# EasyEDA Pro project Cerberus_Sub_Controller_v02.eprj, board Cerberus_Sub_Controller_v02 (continued)
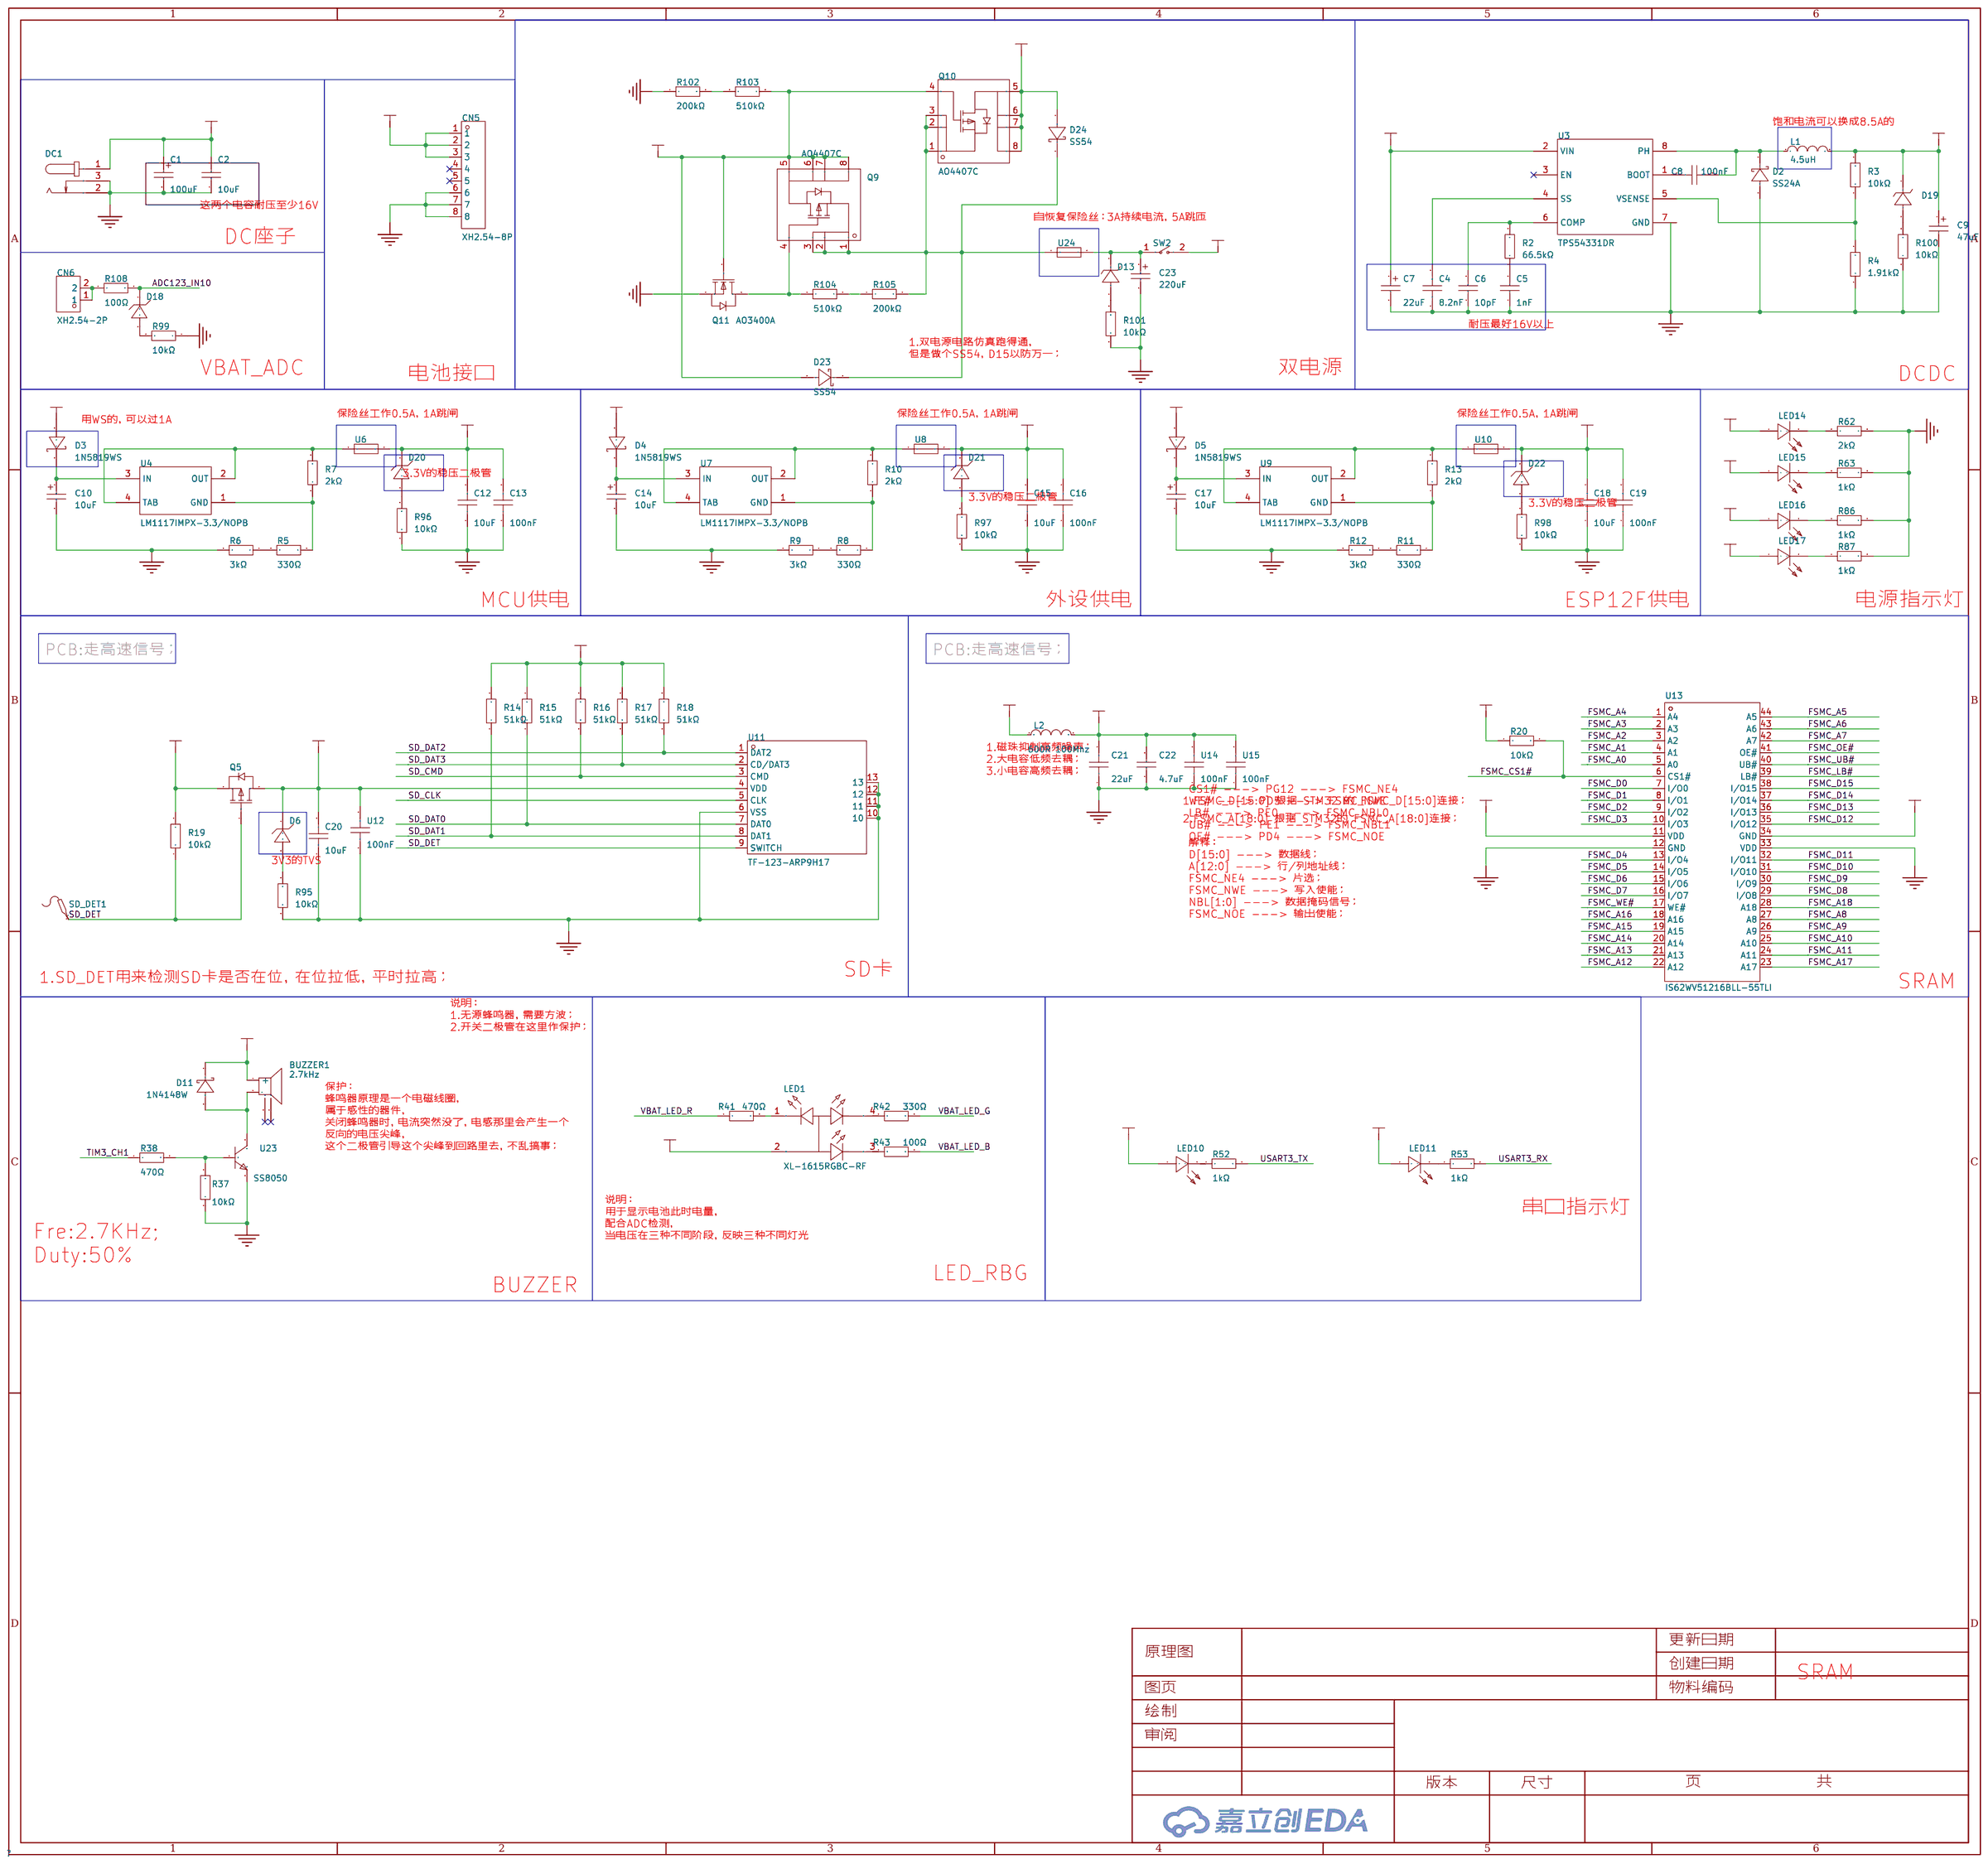
[diagram p0: A1]
## Routing (per net, layer and track width the routed paths; a pad name or vN(x,y) marks a point on that pad's centre or on a via; arc(x,y) is an arc through that point) (continued)
FSMC_A5: length 49.9
  Top Layer w0.203: U31.15 39.55,45.55 38.61,46.49 38.61,46.89 36.85,48.64 36.85,49.39 v1(36.83,49.41) ; 64.29,80.3 65.02,79.57 65.02,74.3 55.4,64.68 v1(54.91,64.68)
  Bottom Layer w0.203: v1(54.91,64.68) 52.19,64.68 36.92,49.41 v1(36.83,49.41)
FSMC_A6: length 34.4
  Top Layer w0.203: U31.50 48.14,66.17 49.02,66.17 50.04,65.16 55.25,65.16 64.52,74.43 64.52,78.95 63.73,79.74
FSMC_A7: length 33.9
  Top Layer w0.203: U13.42 64.01,78.33 64.01,74.55 54.99,65.54 50.29,65.54 49.28,66.55 46.4,66.55 U31.53
FSMC_A8: length 21.7
  Top Layer w0.203: U31.54 48.11,68.97 49.15,68.97 51.44,66.68 53.97,66.68 55.25,67.95 55.25,70.12 U13.27
FSMC_A9: length 20.9
  Top Layer w0.203: U31.55 47.91,69.47 49.28,69.47 51.69,67.06 53.72,67.06 54.74,68.08 54.74,69.5 U13.26
FSMC_A10: length 20.1
  Top Layer w0.203: U13.25 54.23,68.87 54.23,68.2 53.47,67.44 51.94,67.44 49.4,69.98 47.71,69.98 40.26,62.53
FSMC_A11: length 17.9
  Top Layer w0.203: U31.57 48.75,71.73 50.24,71.73 52.98,68.99
FSMC_A12: length 29.6
  Top Layer w0.203: 44.42,76.42 43.87,76.97 33.15,76.97 24.64,68.46 24.64,65.34 U31.87
FSMC_A13: length 31.5
  Top Layer w0.203: 44.98,76.99 44.5,77.47 32.89,77.47 24.13,68.71 24.13,65.16 25.44,63.84 25.44,63.83 U31.88
FSMC_A14: length 33.4
  Top Layer w0.203: 26.04,62.53 23.62,64.95 23.62,68.97 32.77,78.11 44.99,78.11 U13.20
FSMC_A15: length 35.2
  Top Layer w0.203: U13.19 45.62,78.62 32.51,78.62 23.11,69.22 23.11,64.75 25.69,62.17
FSMC_A16: length 30.2
  Top Layer w0.203: U31.80 27.69,67.25 27.69,69.47 33.66,75.44 42.93,75.44 43.81,74.55 45.79,74.55 47.12,75.88 47.12,78.25 46.68,78.69
FSMC_A17: length 28.4
  Top Layer w0.203: v1(49.53,71.25) 49.59,71.25 U13.23 ; U31.81 28.88,65.35 v1(30.35,63.89)
  Bottom Layer w0.203: v1(30.35,63.89) 32.77,63.89 40.13,71.25 v1(49.53,71.25)
FSMC_A18: length 32.5
  Top Layer w0.203: U31.82 27.56,65.96 v1(27.56,66.04) ; U13.28 54.1,72.39 v1(49.78,72.39)
  Bottom Layer w0.203: v1(49.78,72.39) 33.4,72.39 27.56,66.55 v1(27.56,66.04)
FSMC_CS1#: length 57.7
  Top Layer w0.203: 25.69,46.54 25.71,46.54 v1(26.92,47.76) ; v1(48.39,88.02) 48.9,88.52 50.42,88.52 U13.6 54.29,84.66 54.29,82.36 50.42,78.49 v1(50.42,75.95)
  Inner2 w0.381: v1(50.42,75.95) v1(37.34,62.87)
  Bottom Layer w0.203: v1(37.34,62.87) 35.31,60.84 35.31,57.79 26.92,49.41 v1(26.92,47.76)
FSMC_D0: length 45.8
  Top Layer w0.203: U31.85 25.65,65.74 25.65,68.08 33.53,75.95 43.05,75.95 44.07,74.93 45.47,74.93 46.35,75.82 46.35,76.11 v1(46.32,76.14) ; U13.7 50.94,86.87 v1(50.26,86.87)
  Bottom Layer w0.203: v1(46.32,76.14) 46.32,82.94 v1(50.26,86.87)
FSMC_D1: length 45.9
  Top Layer w0.203: v1(45.72,76.09) 44.94,75.31 44.45,75.31 43.31,76.46 33.4,76.46 25.15,68.2 25.15,65.54 U31.86 ; U13.8 50.44,86.24 v1(48.9,86.24)
  Bottom Layer w0.203: v1(45.72,76.09) 45.72,83.06 v1(48.9,86.24)
FSMC_D2: length 64
  Top Layer w0.203: U31.114 18.85,48.9 18.14,48.9 16.89,50.15 16.89,63.76 32.26,79.12 38.86,79.12 45.47,85.73 49.82,85.73 U13.9
FSMC_D3: length 65
  Top Layer w0.203: v1(44.2,85.22) 38.48,79.51 32,79.51 16.38,63.89 16.38,49.92 17.78,48.52 19.18,48.52 U31.115 ; v1(46.74,85.22) 49.19,85.22 U13.10
  Bottom Layer w0.203: v1(46.74,85.22) v1(44.2,85.22)
FSMC_D4: length 22.7
  Top Layer w0.203: U13.13 49.91,81.11 49.91,73.59 U31.58
FSMC_D5: length 21.8
  Top Layer w0.203: 39.19,63.59 49.4,73.79 49.4,80.49 U13.14
FSMC_D6: length 20.8
  Top Layer w0.203: 48.38,80.38 48.9,79.86 48.9,73.99 38.84,63.94
FSMC_D7: length 18.5
  Top Layer w0.203: 38.41,65.59 48.26,75.44 48.26,79.37 U13.16
FSMC_D8: length 22
  Top Layer w0.203: U13.29 54.73,72.9 v1(50.16,72.9) ; v1(44.94,72.92) 44.94,72.86 37.43,65.35
  Bottom Layer w0.203: v1(50.16,72.9) 50.14,72.92 v1(44.94,72.92)
FSMC_D9: length 23.1
  Top Layer w0.203: U13.30 55.35,73.41 v1(50.55,73.41) ; v1(44.45,73.41) 43.43,72.39 43.43,72.07 U31.65
  Bottom Layer w0.203: v1(50.55,73.41) v1(44.45,73.41)
FSMC_D10: length 24.2
  Top Layer w0.203: v1(43.94,73.92) 43.05,73.03 43.05,72.39 U31.66 ; v1(50.93,73.92) 55.97,73.92 U13.31
  Bottom Layer w0.203: v1(50.93,73.92) v1(43.94,73.92)
FSMC_D11: length 25.5
  Top Layer w0.203: U13.32 56.62,74.4 v1(51.31,74.4) ; v1(42.67,73.92) 42.67,72.72 U31.67
  Bottom Layer w0.203: v1(51.31,74.4) 43.15,74.4 v1(42.67,73.92)
FSMC_D12: length 27.8
  Top Layer w0.203: v1(51.69,74.93) 52.45,75.7 58.72,75.7 U13.35 ; U31.68 42.04,72.79 v1(42.04,74.05)
  Bottom Layer w0.203: v1(42.04,74.05) 42.93,74.93 v1(51.69,74.93)
FSMC_D13: length 37.4
  Top Layer w0.203: U13.36 59.34,76.2 52.2,76.2 v1(51.69,75.7) ; 30.28,66.77 30.26,66.77 28.96,68.08 28.96,70.11 33.78,74.93 v1(41.53,74.93)
  Bottom Layer w0.203: v1(41.53,74.93) 41.91,75.31 51.31,75.31 v1(51.69,75.7)
FSMC_D14: length 40.9
  Top Layer w0.203: v1(47.76,67.94) 48.15,68.33 49.15,68.33 51.18,66.3 54.23,66.3 55.63,67.69 55.63,69.73 60.83,74.93 60.83,75.85 60.34,76.34 ; U31.78 32.33,64.01 33.66,64.01 v1(34.67,65.03)
  Bottom Layer w0.203: v1(47.76,67.94) 37.58,67.94 v1(34.67,65.03)
FSMC_D15: length 42.8
  Top Layer w0.203: U13.38 61.34,76.47 61.34,74.74 56.01,69.41 56.01,67.44 54.48,65.92 50.8,65.92 49.02,67.69 48.26,67.69 v1(47.75,67.19) ; U31.79 32.52,63.12 v1(32.64,63.12)
  Bottom Layer w0.203: v1(47.75,67.19) 37.59,67.19 33.53,63.12 v1(32.64,63.12)
FSMC_LB#: length 50.6
  Top Layer w0.203: U31.141 32.13,43.09 32.13,46.87 v1(36.7,51.44) ; v1(56.77,69.47) 62.28,74.99 62.28,76.66 U13.39
  Bottom Layer w0.203: v1(56.77,69.47) 53.21,65.92 51.05,65.92 36.7,51.57 v1(36.7,51.44)
FSMC_OE#: length 55.6
  Top Layer w0.203: v1(56.75,67.97) 63.5,74.72 63.5,77.7 U13.41 ; v1(42.54,55.88) 38.61,51.95 24.73,51.95 U31.118
  Bottom Layer w0.203: v1(56.75,67.97) 53.93,65.16 51.82,65.16 v1(42.54,55.88)
FSMC_UB#: length 51.7
  Top Layer w0.203: v1(56.77,68.71) 62.85,74.79 62.85,77.22 U13.40 ; 30.99,41.24 32.64,42.89 32.64,46.61 v1(37.47,51.44)
  Bottom Layer w0.203: v1(37.47,51.44) 37.47,51.69 51.31,65.54 53.59,65.54 v1(56.77,68.71)
FSMC_WE#: length 64.3
  Top Layer w0.203: U31.119 20.74,47.25 18.42,47.25 15.88,49.79 15.88,64.01 31.88,80.01 38.1,80.01 v1(41.53,83.44) ; 47.25,79.25 45.09,81.41
  Bottom Layer w0.203: v1(41.53,83.44) 43.05,83.44 v1(45.09,81.41)
I2C1_SCL: length 61.9
  Top Layer w0.203: v1(24.38,23.89) 21.72,26.56 21.72,34.09 U31.139 ; 22.28,18.22 24.38,20.32 24.38,23.88 ; 22.28,18.22 R74.2 ; 22.28,18.22 22.28,16.06 20.32,14.1 20.32,7.24 19.18,6.1 6.62,6.1 CN4.2
  Bottom Layer w0.203: v1(24.38,23.89) 24.38,22.74 24.13,22.48 R69.2
I2C1_SDA: length 65.3
  Top Layer w0.203: CN4.1 20.19,4.45 24.64,8.89 24.64,13.47 23.82,14.28 R21.2 22.99,18.16 26.29,21.47 v1(26.29,23.88) 25.27,24.9 25.27,26.8 22.22,29.85 22.22,33.89 30.28,41.95
  Bottom Layer w0.203: R68.2 25.27,21.21 26.29,22.23 R70.1
LC02_CS: length 24.1
  Top Layer w0.203: U31.73 31.64,68.18 30.48,69.35 30.48,70.87 33.78,74.17 v1(37.85,74.17) ; v1(38.42,81.22) 38.42,84.01 37.72,84.71 R32.1
  Bottom Layer w0.203: v1(37.85,74.17) 37.97,74.17 38.42,74.62 v1(38.42,81.22)
LC02_CS_R: length 9.3
  Top Layer w0.203: v1(37.72,88.74) R32.2 R107.2
  Bottom Layer w0.203: 37.72,88.78 36.19,88.78 35.94,89.03 35.94,90.05 35.56,90.43 34.42,90.43 34.14,90.15 CN3.5
LC02_RXD: length 3.3
  Top Layer w0.203: R31.2 R27.1 33.46,88.79 v1(33.14,89.11)
LC02_TXD: length 1.9
  Top Layer w0.203: v1(32,88.79) R30.2
  Bottom Layer w0.203: CN3.3 32.14,88.92 v1(32,88.79)
LIS_CS: length 4.7
  Bottom Layer w0.203: R23.2 22.99,11.88 21.02,13.85 U17.3
  vias: v1(22.99,11.99)
LIS_INT: length 80.6
  Top Layer w0.203: v1(36.32,17.91) 36.32,12.85 35.57,12.1 R78.2 v1(30.86,12.07) ; v1(48.83,56.84) 48.83,57.85 47.75,58.93 46.56,58.93 45.21,57.58 ; v1(15.93,12.07) 15.93,13.33 v1(15.92,13.34)
  Bottom Layer w0.203: v1(15.92,13.34) 16.95,13.34 16.96,13.35 U17.7 ; v1(48.83,56.84) 36.32,44.33 v1(36.32,17.91) ; 15.88,12.07 15.88,11.31 17.27,9.91 23.11,9.91 25.27,12.07 v1(30.86,12.07)
LIS_SCL: length 4.3
  Top Layer w0.203: R72.1 v1(19.56,17.35) R74.1
  Bottom Layer w0.203: v1(19.56,17.35) 19.56,15.25 U17.1
LIS_SDA: length 8.5
  Top Layer w0.203: v1(19.84,13.34) 19.84,13.82 18.11,15.55 R73.1 ; v1(20.83,13.35) 20.89,13.41 R21.1
  Bottom Layer w0.203: U17.4 v1(20.83,13.35)
MPU6050_AUX_CL: length 5.6
  Top Layer w0.203: v1(16.26,19.82) 16.89,19.18 18.5,19.18 19.5,18.18 R72.2
  Bottom Layer w0.203: U16.7 16.29,19.85 v1(16.26,19.82)
MPU6050_AUX_DA: length 3
  Bottom Layer w0.203: v1(18.03,18.16) 17.04,19.16 U16.6
MPU6050_INT: length 52.7
  Top Layer w0.203: U31.22 42.97,47.01 42.97,46.03 41.53,44.58 41.53,42.04 45.34,38.23 45.34,35.06 43.43,33.15 23.37,33.15 v1(22.73,32.52)
  Bottom Layer w0.203: R67.1 13.92,24.13 v1(13.92,26.14) ; 13.97,26.29 20.19,32.52 v1(22.73,32.52)
NRST: length 102.7
  Top Layer w0.203: 3.68,43.56 2.79,43.56 1.65,42.42 1.65,23.25 3.01,21.89 C58.1 R89.2 ; U31.25 44.09,48.01 46.1,48.01 46.74,48.64 50.16,48.64 52.45,46.36 52.45,41.28 43.69,32.52 v1(23.62,32.52)
  Bottom Layer w0.203: 3.68,43.56 13.59,43.56 14.61,42.55 14.61,41.53 v1(23.62,32.52)
  vias: v1(6.66,23.71)
OSC32_IN: length 9.2
  Top Layer w0.254: U31.8 40.14,39.95 40.14,36.46 39.31,35.63 C57.2
OSC32_OUT: length 8.3
  Top Layer w0.254: X2.2 41.91,38.49 C56.2 41.66,40.26 40.53,40.26 37.43,43.36
OSC_IN: length 13.4
  Top Layer w0.254: R88.1 47.65,42.37 46.83,43.18 45.68,42.04 C55.2 44.45,42.04 43.69,42.8 43.69,44.2 44.83,45.34 44.83,45.86 U31.23
OSC_OUT: length 13.5
  Top Layer w0.254: U31.24 45.16,46.23 46.89,46.23 47.15,45.98 47.74,45.98 C54.2 50.03,46.87 50.8,46.11 50.8,44.2 R88.2
PDR_ON: length 5.7
  Top Layer w0.203: U31.143 30.39,39.94 30.39,38.19 v1(31.24,37.34)
  Bottom Layer w0.508: v1(31.24,37.34) R40.2
SD_CLK: length 16.8
  Top Layer w0.203: U31.113 18.78,49.53 18.29,49.53 17.52,50.3 v1(17.52,50.93)
  Bottom Layer w0.203: v1(17.52,50.93) 17.4,51.05 17.4,52.58 14.94,55.04 U11.5
SD_CMD: length 19.2
  Top Layer w0.203: v1(19.56,48.14) 19.56,48.19 U31.116 ; R16.1 8.43,52.97 v1(8.3,52.84)
  Bottom Layer w0.203: 19.43,48.14 16.89,50.68 16.89,52.33 16.38,52.84 v1(8.3,52.84)
SD_DAT0: length 17.2
  Top Layer w0.203: v1(17.78,60.96) 21.24,60.96 U31.98
  Bottom Layer w0.203: v1(17.78,60.96) 15.37,60.96 13.08,58.68 10.19,58.68 v1(10.03,58.52) 10.03,57.79 9.48,57.24 U11.7
SD_DAT1: length 16.5
  Top Layer w0.203: U31.99 21.17,60.33 v1(17.78,60.33) ; v1(11.3,58.17) 10.54,57.41 8.89,57.41 8.38,57.92 v1(8.38,58.34)
  Bottom Layer w0.203: v1(17.78,60.33) 15.37,60.33 13.21,58.17 v1(11.3,58.17)
SD_DAT2: length 19.3
  Top Layer w0.203: U31.111 20.7,52.87 20.7,53.6 v1(20.32,53.98) ; v1(14.48,56.39) 14.48,53.96 13.49,52.97 R18.1 13.43,52.97 11.1,50.64 v1(8.3,50.64)
  Bottom Layer w0.203: v1(14.48,56.39) 14.73,56.65 17.65,56.65 v1(20.32,53.98)
SD_DAT3: length 22.5
  Top Layer w0.203: R17.1 11.78,52.97 10.55,51.74 v1(8.3,51.74) ; U31.112 19.09,50.55 18.58,50.55 18,51.13 v1(18,51.6)
  Inner2 w0.381: v1(8.3,51.74) 9.27,52.71 9.27,54.87 10.03,55.63 v1(13.97,55.63)
  Bottom Layer w0.203: v1(18,51.6) 18,52.61 14.99,55.63 v1(13.97,55.63)
SD_DET: length 15.9
  Top Layer w0.381: R19.1 6.53,55.44 v1(5.19,55.44)
  Bottom Layer w0.203: SD_DET1.1 8.26,47.38 5.84,47.38 4.32,48.9 4.32,52.71 5.19,53.58 v1(5.19,55.44)
  Bottom Layer w0.381: v1(6.73,55.6) 6.73,54.61 7.06,54.29 8.3,54.29
SPI1_CLK: length 41.3
  Top Layer w0.203: v1(24.38,38.23) 24.38,41 U31.133
  Bottom Layer w0.203: v1(24.38,38.23) 24.38,30.99 28.57,26.8 28.57,15.37 33.91,10.04 35.43,10.04
  vias: v1(35.53,10.04)
SPI1_CS: length 60.7
  Top Layer w0.203: U31.104 22.2,55.76 23.11,55.76 26.42,52.45 v1(30.99,52.45)
  Inner2 w0.381: v1(51.82,20.58) 54.61,17.78 v1(54.61,14.1) ; v1(34.29,38.1) v1(44.45,27.94)
  Bottom Layer w0.203: v1(34.29,38.1) 32.38,40.01 32.38,51.69 31.62,52.45 v1(30.99,52.45) ; v1(44.45,27.94) v1(51.82,20.58)
SPI1_MOSI: length 38.1
  Top Layer w0.203: U31.135 25.02,40.22 v1(25.02,38.99)
  Bottom Layer w0.203: 35.56,14.16 30.92,14.16 29.97,15.12 29.97,18.29 29.08,19.18 29.08,27.31 25.02,31.37 v1(25.02,38.99)
  vias: v1(35.54,14.1)
SWCLK: length 34.7
  Top Layer w0.203: v1(12.7,57.15) v1(12.7,53.72) ; v1(12.57,48.14) 11.3,46.87 11.3,42.93 6.86,38.48 H12.4 ; 19.33,52.91 17.78,54.45 v1(17.78,57.15)
  Inner2 w0.381: v1(12.57,48.14) 12.57,53.6 v1(12.7,53.72)
  Bottom Layer w0.203: v1(17.78,57.15) 17.27,57.66 13.21,57.66 v1(12.7,57.15)
SWDIO: length 32.3
  Top Layer w0.203: v1(14.99,58.55) 14.99,51.57 10.67,47.25 10.67,43.06 8.64,41.03 H12.3 ; v1(17.91,59.44) 17.91,59.35 U31.105
  Bottom Layer w0.203: v1(17.91,59.44) 15.37,59.44 14.99,59.06 v1(14.99,58.55)
TIM3_CH1: length 21.4
  Top Layer w0.203: R38.1 20.95,70.37 v1(21.21,70.11) ; U31.96 22.61,61.01 v1(22.61,68.71)
  Bottom Layer w0.203: v1(22.61,68.71) v1(21.21,70.11)
UART4_RX: length 50.6
  Top Layer w0.203: 46.62,52.56 47.57,51.6 48.04,51.6 54.36,57.92 54.36,59.95 59.82,65.41 61.09,65.41 79.21,83.53 R36.1
UART4_TX: length 52.3
  Top Layer w0.203: U31.34 47.22,51.25 48.2,51.25 54.74,57.79 54.74,59.76 59.88,64.9 61.09,64.9 81.75,85.57 R35.1
USART1_RX: length 32
  Top Layer w0.203: U31.102 20.32,59.06 v1(20.32,59.69)
  Bottom Layer w0.203: H11.2 4.28,79.51 10.89,72.89 R33.1 10.95,72.89 11.7,72.14 15.62,72.14 20.32,67.44 v1(20.32,59.69)
USART1_TX: length 33.3
  Top Layer w0.203: U31.101 20.95,59.13 v1(20.95,59.69)
  Bottom Layer w0.203: v1(20.95,59.69) 20.95,67.57 15.63,72.89 R34.1 12.8,72.89 3.65,82.05 H11.3
USART2_RX: length 103.1
  Top Layer w0.203: v1(48.64,53.47) 48.64,54.14 U31.37 47.34,56.17 47.47,56.17 47.76,55.88 48.77,55.88 59.56,66.68 59.56,67.06 60.58,68.08 61.09,68.08 70.36,77.35 70.36,90.05 H4.2
  Bottom Layer w0.203: v1(48.64,53.47) 51.69,53.47 55.12,50.04 55.12,23.5 58.8,19.82 58.8,9.4 59.82,8.39 H8.2
USART2_TX: length 91.8
  Top Layer w0.203: v1(48.9,55.25) 59.82,66.17 60.71,66.17 61.59,67.06 61.59,67.69 70.87,76.97 H4.3 ; v1(47.62,53.47) 47.06,52.91 U31.36
  Bottom Layer w0.203: H9.2 60.07,19.31 55.63,23.75 55.63,50.17 51.84,53.95 48.1,53.95 ; 48.1,53.95 48.9,54.74 v1(48.9,55.25) ; 48.1,53.95 v1(47.62,53.47)
USART3_RX: length 27.2
  Top Layer w0.203: v1(40.26,73.03) 40.26,72.43 35.31,67.47 ; v1(32.38,83.44) 32.38,83.69 R53.2 R30.1
  Inner2 w0.381: v1(32.38,83.44) 33.91,83.44 34.29,83.06 38.74,83.06 40.26,81.54 v1(40.26,73.03)
USART3_TX: length 26.2
  Top Layer w0.203: R31.1 34.8,84.2 ; v1(40.89,73.03) 40.89,72.36 U31.69 ; v1(34.8,83.7) R52.2
  Inner2 w0.381: v1(40.89,73.03) 40.89,81.79 38.99,83.7 v1(34.8,83.7)
  Bottom Layer w0.381: v1(34.8,83.7) 34.91,83.58 TP19.1
$1N1726: length 1.8
  Top Layer w0.508: C4.2 87.53,51.88 U3.4
$1N1843: length 1.8
  Bottom Layer w0.508: C5.2 R2.1
$1N1949: length 2.2
  Bottom Layer w0.508: v1(86.24,57.28) 86.29,57.23 C6.2
$1N2122: length 2.5
  Top Layer w0.508: U3.1 v1(83.69,54.42)
$1N2501: length 3.8
  Top Layer w0.508: U3.5 87.54,57.28 R4.2 89.53,57.29 R3.1
$1N2585:
  vias: v1(79.12,60.08) v1(79.12,59.18) v1(79.12,58.17) v1(80.23,60.1) v1(80.23,59.2) v1(80.23,58.19) v1(80.23,57.12) v1(81.46,60.1) v1(81.46,59.2) v1(81.46,58.19) v1(81.46,57.12) v1(82.59,60.1) v1(82.59,59.2) v1(82.59,58.19) v1(82.59,57.12) v1(83.69,60.1) v1(83.69,59.2) v1(83.69,58.19) v1(83.69,57.12) v1(83.69,55.76)
$1N3113: length 1.5
  Bottom Layer w0.508: R5.2 69.99,57.92 R6.1
$1N3446: length 0.9
  Bottom Layer w0.508: R7.2 v1(68.45,58.81)
  vias: v2(66.29,60.08)
$1N4301: length 1.5
  Bottom Layer w0.508: R9.1 69.86,46.61 R8.2
$1N4315: length 0.9
  Bottom Layer w0.508: v1(68.33,47.5) R10.2
  vias: v2(66.17,48.77)
$1N4707: length 1.5
  Bottom Layer w0.508: R11.2 69.6,35.56 R12.1
$1N4721: length 0.8
  Bottom Layer w0.508: v2(68.01,36.33) 68.07,36.26 R13.2
  vias: v2(65.91,37.34)
$1N4748:
  vias: v2(68.07,34.03) v2(69.6,34.03)
$1N4784:
  vias: v2(68.33,45.12) v2(69.85,45.12)
$1N4807:
  vias: v2(68.45,56.38) v2(70.1,56.38)
$1N4899: length 2.6
  Top Layer w0.762: v2(71.73,60.96) 69.29,60.96 U4.3
$1N4974: length 2.6
  Top Layer w0.762: C14.1 71.27,49.8 U7.3
  vias: v2(71.73,49.53)
$1N5020: length 3.1
  Top Layer w0.762: v2(71.75,38.46) C17.1 71.65,38.63 U9.3
$1N9180: length 2.2
  Top Layer w0.508: BUZZER.2 18.42,84.71 v1(16.47,84.71)
  vias: v1(18.54,84.06)
$1N9181: length 1.7
  Bottom Layer w0.203: U23.1 19.4,81.97 v1(19.4,80.39)
$1N9349: length 5.8
  Bottom Layer w0.203: v1(7.63,32.77) 5.59,32.77 4.76,31.94 4.76,30.42 5.12,30.06 Battery_led.1
$1N9353: length 0.4
  Top Layer w0.203: R43.1 7.37,30.92 v1(7.34,30.92)
$1N9484: length 0.7
  Top Layer w0.203: v1(7.23,30) 7.63,29.61 R42.1
$1N10259: length 1.6
  Top Layer w0.203: R52.1 34.89,82.47 v1(34.89,81)
$1N10263: length 1.6
  Top Layer w0.203: v1(31.55,81.15) 32,81.6 R53.1
$1N11173:
  vias: v1(86.46,37.88) v1(86.46,36.58) v1(86.46,35.22) v1(86.46,33.92) v1(86.49,32.75) v1(86.49,31.52) v1(88.1,37.88) v1(88.1,36.58) v1(88.1,35.22) v1(88.1,33.92) v1(88.13,32.75) v1(88.13,31.52) v1(89.55,37.88) v1(89.55,36.58) v1(89.55,35.22) v1(89.55,33.92) v1(89.58,32.75) v1(89.58,31.52) v1(89.88,39.37) v1(91.06,39.37) v1(91.08,37.88) v1(91.08,36.58) v1(91.08,35.22) v1(91.08,33.92) v1(91.11,32.75) v1(91.11,31.52)
$1N12165:
  vias: v1(78.61,44.49)
$1N12423:
  vias: v1(73.03,68.04)
$1N13016:
  vias: v1(56.26,55.6)
$1N13023: length 2.3
  Bottom Layer w0.381: MCU_3V3#2.2 62.35,69.57 R87.1
$1N13155: length 2.3
  Top Layer w0.381: R95.2 6,50.3 D6.2
$1N13401: length 2.6
  Bottom Layer w0.635: R97.2 64.01,48.87
$1N13531: length 2.2
  Top Layer w0.381: D18.2 83.1,74.4 R99.2
$1N13687: length 1.8
  Bottom Layer w0.508: 87.11,62.95 86.9,62.75 D19.2
$1N13763: length 2.5
  Bottom Layer w0.635: R96.2 D20.2
$1N13849: length 2.4
  Bottom Layer w0.635: D22.2 R98.2
$1N13895: length 1.8
  Bottom Layer w0.508: D13.2 R101.2
$1N18758: length 1.8
  Top Layer w0.762: R103.1 R102.2
$1N19044: length 1.8
  Bottom Layer w0.762: R105.1 R104.2
$1N19049:
  vias: v1(84.96,21.48)
$1N19262:
  vias: v1(82.44,28.58) v1(82.44,27.31) v1(82.44,26.04) v1(83.69,28.58) v1(83.69,27.47) v1(83.69,26.42) v1(84.99,28.55) v1(84.99,27.44) v1(84.96,26.29) v1(86.23,28.55) v1(86.23,27.44) v1(86.23,26.04) v1(86.23,24.64) v1(86.23,23.04) v1(86.23,21.48) v1(87.5,28.55) v1(87.5,27.44) v1(87.5,26.04) v1(87.5,24.64) v1(87.5,23.04) v1(87.5,21.48) v1(88.77,28.55) v1(88.77,27.44) v1(88.77,26.04) v1(88.77,24.64) v1(88.77,23.04) v1(88.77,21.48) v1(89.82,19.31) v1(90.17,28.53) v1(90.17,27.42) v1(90.17,26.02) v1(90.17,24.63) v1(90.17,23.02) v1(90.17,21.47) v1(91.41,28.53) v1(91.41,27.42) v1(91.41,26.02) v1(91.41,24.63) v1(91.41,23.02) v1(91.41,21.47)
$1N26422: length 4.9
  Top Layer w0.381: R108.1 86.75,78.22 CN6.1 CN6.2
$2N204: length 3.4
  Bottom Layer w0.254: USB1.4 4.97,67.72 4.44,67.19 4.44,66.52 v1(4.35,66.42)
$2N205: length 2.8
  Bottom Layer w0.254: USB1.10 5.27,70.72 v1(4.35,71.63)
$2N447: length 3.7
  Bottom Layer w0.203: R34.2 12.83,69.47 13.84,68.46 v1(14.24,68.46)
$2N448: length 6.8
  Bottom Layer w0.203: R33.2 10.92,68.46 12.19,67.19 v1(14.24,67.19)
$2N1006: length 1.9
  Top Layer w0.203: R36.2 79.21,89.99 U22.3
$2N1007: length 1.9
  Top Layer w0.203: U22.2 81.75,90.03 R35.2
$2N1573: length 1.4
  Bottom Layer w0.203: U16.9 14.92,22.49 R66.2
$2N1574: length 1.5
  Bottom Layer w0.203: U16.10 15.75,22.99 15.49,23.25 v1(14.9,23.25)
$2N1575: length 1.4
  Bottom Layer w0.203: U16.12 14.93,23.99 R67.2
$2N1580: length 1.4
  Bottom Layer w0.203: U16.20 20.98,23.49 C26.1
$2N1581: length 1.6
  Bottom Layer w0.203: R68.1 21.52,21.49 U16.24
$2N1582: length 1.7
  Bottom Layer w0.203: U16.23 21.3,21.99 R69.1
$2N2781: length 1.7
  Bottom Layer w0.203: U17.5 18.54,11.98 C30.2
$2N7074: length 2.9
  Top Layer w0.203: v1(37.66,6.13) 35.46,6.13 35.43,6.11 R75.2
$2N7151: length 5.2
  Top Layer w0.203: R85.2 58.2,5.18 57.53,5.85
  Inner2 w0.381: H8.1 57.53,5.85
$2N7152: length 5.1
  Top Layer w0.203: R76.2 58.16,15.76 57.53,16.39
  Inner2 w0.381: H9.1 57.53,16.39
$2N7340: length 5.3
  Top Layer w0.203: v1(33.5,18.65) 31.69,18.65 30.73,17.69 R81.2 30.67,17.6 C52.2
$2N7398: length 4.4
  Top Layer w0.203: v1(26.32,3.08) 26.47,2.93 C53.2 28.76,4.78 R84.2
$3N7064:
  vias: v1(12.45,45.42)
$3N7085:
  vias: v1(12.45,42.34)
$3N7148: length 1.8
  Top Layer w0.203: v1(6.28,19.18) 6.66,19.57 C58.2

## Copper pours and planes (outline as drawn; the poured copper is in the pictures)
GND on Top Layer: -4.7,96.91 98.68,96.91 98.68,-9.14 -4.7,-9.14
GND on Bottom Layer: -3.56,99.06 99.57,99.06 99.57,-6.73 -3.56,-6.73
GND on Inner1: 0.26,94.74 94.74,94.74 94.74,0.26 0.26,0.26
GND on Inner2: -1.65,97.29 98.43,97.29 98.43,-8.12 -1.65,-8.12
VCC_5V on Top Layer: 75.18,51.06 74.39,50.26 73.37,50.26 73.15,50.04 73.15,49.03 73.37,48.81 74.39,48.81 75.18,48.01
VCC_5V on Top Layer: 81.41,69.6 80.52,70.49 80.52,70.74 80.01,70.74 80.01,70.49 78.65,68.97 81.99,68.97
VCC_5V on Top Layer: 78.49,69.6 75.56,69.6 74.8,68.84 74.8,49.12 74.84,49.08 74.84,38.1 75.09,37.85 77.09,37.85 77.47,38.23 77.47,63.07 78.15,63.75 78.15,69.27
VCC_5V on Top Layer: 85.34,63.69 86.05,64.4 86.05,68.9 85.34,69.6 78.36,69.6 77.6,68.84 77.6,64.25 78.15,63.69
VCC_5V on Top Layer: 75.18,62.49 74.39,61.69 73.37,61.69 73.15,61.47 73.15,60.46 73.37,60.24 74.39,60.24 75.18,59.44
VCC_5V on Top Layer: 75.31,37.85 73.28,37.85 73.15,37.98 73.15,39.25 73.28,39.37 74.6,39.37 75.03,39.8 75.31,39.52
VCC_5V on Bottom Layer: 78.49,69.6 75.56,69.6 74.8,68.84 74.8,49.12 74.84,49.08 74.84,38.07 75.06,37.85 77.09,37.85 77.47,38.23 77.47,63.07 78.15,63.75 78.15,69.27
VCC_5V on Bottom Layer: 75.18,62.49 74.39,61.69 73.37,61.69 73.15,61.47 73.15,60.46 73.37,60.24 74.39,60.24 75.18,59.44
VCC_5V on Bottom Layer: 85.34,63.69 86.05,64.4 86.05,68.9 85.34,69.6 78.36,69.6 77.6,68.84 77.6,64.25 78.15,63.69
VCC_5V on Bottom Layer: 75.31,37.85 73.28,37.85 73.15,37.98 73.15,39.25 73.28,39.37 74.6,39.37 75.03,39.8 75.31,39.52
VCC_5V on Bottom Layer: 75.18,51.06 74.39,50.26 73.37,50.26 73.15,50.04 73.15,49.03 73.37,48.81 74.39,48.81 75.18,48.01
VCC_5V on Inner2: 78.49,69.6 75.56,69.6 74.8,68.84 74.8,49.12 74.84,49.08 74.84,38.07 75.06,37.85 77.09,37.85 77.47,38.23 77.47,63.07 78.15,63.75 78.15,69.27
VCC_5V on Inner2: 75.18,51.06 74.39,50.26 73.37,50.26 73.15,50.04 73.15,49.03 73.37,48.81 74.39,48.81 75.18,48.01
VCC_5V on Inner2: 75.31,37.85 73.28,37.85 73.15,37.98 73.15,39.25 73.28,39.37 74.6,39.37 75.03,39.8 75.31,39.52
VCC_5V on Inner2: 75.18,62.49 74.39,61.69 73.37,61.69 73.15,61.47 73.15,60.46 73.37,60.24 74.39,60.24 75.18,59.44
VCC_5V on Inner2: 85.34,63.69 86.05,64.4 86.05,68.9 85.34,69.6 78.36,69.6 77.6,68.84 77.6,64.25 78.15,63.69
VCC_7V4 on Top Layer: 84.76,43.18 83.87,44.08 83.87,50.47 84.33,50.93 84.33,53.47 84.71,53.85 85.49,53.85 85.49,53.83 85.72,53.6 85.72,50.93 87.07,49.59 89.23,49.59 90.04,48.77 90.04,43.82 89.41,43.18
VCC_7V4 on Bottom Layer: 84.76,43.18 83.87,44.08 83.87,50.47 84.33,50.93 84.33,53.47 84.71,53.85 85.49,53.85 85.49,53.83 85.72,53.6 85.72,50.93 87.07,49.59 89.23,49.59 90.04,48.77 90.04,43.82 89.41,43.18
VCC_7V4 on Inner2: 84.76,43.18 83.87,44.08 83.87,50.47 84.33,50.93 84.33,53.47 84.71,53.85 85.49,53.85 85.49,53.83 85.72,53.6 85.72,50.93 87.07,49.59 89.23,49.59 90.04,48.77 90.04,43.82 89.41,43.18
VCC_BAT_7V4 on Top Layer: 73.03,21.34 70.74,21.34 69.6,22.48 69.6,28.58 70.61,29.59 78.45,29.59 78.87,29.17 78.87,24.01 78.49,23.63 74,23.63 73.43,23.06 73.43,21.74
VCC_BAT_7V4 on Bottom Layer: 72.96,21.33 70.67,21.33 69.53,22.47 69.53,28.57 70.54,29.58 78.38,29.58 78.8,29.16 78.8,24 78.42,23.61 73.93,23.61 73.36,23.05 73.36,21.73
VCC_BAT_7V4 on Inner2: 73.03,21.34 70.74,21.34 69.6,22.48 69.6,28.58 70.61,29.59 78.45,29.59 78.87,29.17 78.87,24.01 78.49,23.63 74,23.63 73.43,23.06 73.43,21.74
VCC_DC_7V4 on Top Layer: 92.71,17.78 90.17,17.78 89.66,17.28 84.07,17.28 83.31,18.04 83.31,20.71 83.06,20.96 82.04,20.96 81.79,20.71 81.79,16.77 83.31,15.24 83.31,10.93 83.06,10.67 83.06,8.89 83.57,8.39 88.01,8.39 88.65,9.02 88.65,13.5 89.38,14.23 91.69,14.23 92.71,15.24
VCC_DC_7V4 on Bottom Layer: 92.71,17.78 90.17,17.78 89.66,17.28 84.07,17.28 83.31,18.04 83.31,20.71 83.06,20.96 82.04,20.96 81.79,20.71 81.79,16.77 83.31,15.24 83.31,10.93 83.06,10.67 83.06,8.89 83.57,8.39 88.01,8.39 88.65,9.02 88.65,13.47 89.41,14.23 91.69,14.23 92.71,15.24
VCC_DC_7V4 on Inner2: 92.71,17.78 90.17,17.78 89.66,17.28 84.07,17.28 83.31,18.04 83.31,20.71 83.06,20.96 82.04,20.96 81.79,20.71 81.79,16.77 83.31,15.24 83.31,10.93 83.06,10.67 83.06,8.89 83.57,8.39 88.01,8.39 88.65,9.02 88.65,13.5 89.38,14.23 91.69,14.23 92.71,15.24
VCC_ESP_3V3 on Bottom Layer: 67.05,39.12 67.31,39.38 67.31,40.9 66.8,41.41 57.91,41.41 57.4,40.9 57.4,39.63 57.92,39.12
VCC_ESP_3V3 on Inner2: 44.96,18.39 43.97,19.31 46.35,19.31 45.44,18.39
VCC_ESP_3V3 on Inner2: 67.05,39.11 67.31,39.37 67.31,40.9 66.8,41.41 57.91,41.41 57.4,40.9 57.4,39.63 57.92,39.11
VCC_FSMC_3V3 on Bottom Layer: 55,80.27 57.2,82.48 59.05,82.48 59.77,81.75 59.81,81.75 59.81,81.28 57.03,78.49 56.83,78.49 55.04,80.27
VCC_MCU_3V3 on Bottom Layer: 67.85,61.71 68.11,61.97 68.11,63.49 67.6,64 57.69,64 57.31,63.62 57.31,62.22 57.83,61.71
VCC_MCU_3V3 on Inner2: 67.81,61.72 68.07,61.98 68.07,63.76 67.82,64.02 57.79,64.02 57.28,63.51 57.28,62.24 57.79,61.72
VCC_PER_3V3 on Bottom Layer: 67.38,50.74 67.64,51 67.64,52.52 67.13,53.03 58.24,53.03 57.73,52.52 57.73,51.25 58.25,50.74
VCC_PER_3V3 on Bottom Layer: 16,15.06 17.2,15.06 17.41,14.85 17.41,14.35 17.2,14.14 15.83,14.14 15.75,14.23 15.75,14.81
VCC_PER_3V3 on Inner2: 18.92,28.83 18.92,29.85 20.32,28.45 19.3,28.45
VCC_PER_3V3 on Inner2: 26.03,79.76 26.78,79.01 26.78,78.72 26.04,77.98 26.03,77.98
VCC_PER_3V3 on Inner2: 67.41,50.7 67.67,50.96 67.67,52.49 67.17,53 58.28,53 57.77,52.49 57.77,51.22 58.28,50.7
VCC_PER_3V3 on Inner2: 27.56,86.75 27.56,89.73 28.13,90.3 30.2,90.3 30.42,90.08 30.42,87.02 29,85.6 28.71,85.6
VCC_PER_3V3 on Inner2: 25.91,83.19 27.31,81.79 27.31,81.28 25.91,79.73
VCC_PER_3V3 on Inner2: 14.73,60.2 15.62,61.09 15.62,59.03 14.73,59.92
VCC_PER_3V3 on Inner2: 14.86,63.89 15.88,64.9 15.88,62.36 14.86,63.38
VCC_PER_3V3 on Inner2: 15.11,54.75 15.13,54.75 15.75,55.38 15.75,53.7 15.11,54.34
VCC_PER_3V3 on Inner2: 11.05,15.5 11.68,14.86 11.68,14.45 11.65,14.45 11.05,13.85
VCC_PER_3V3 on Inner2: 15.62,35.66 15.62,33.91 14.81,34.72 14.81,34.85
VCC_PER_3V3 on Inner2: 16.61,31.12 16.76,31.27 16.76,32.26 18.03,30.99 17.27,30.99 17.02,30.74 16.99,30.74
$1N2585 on Top Layer: 84.33,55.73 83.97,55.37 82.73,55.37 81.61,56.49 79.41,56.49 78.49,57.42 78.49,61.22 78.74,61.47 83.31,61.47 84.33,60.46
$1N2585 on Bottom Layer: 84.33,55.73 83.97,55.37 82.73,55.37 81.61,56.49 79.41,56.49 78.49,57.42 78.49,61.22 78.74,61.47 83.31,61.47 84.33,60.46
$1N2585 on Inner2: 84.33,55.73 83.97,55.37 82.73,55.37 81.61,56.49 79.41,56.49 78.49,57.42 78.49,61.22 78.74,61.47 83.31,61.47 84.33,60.46
$1N3446 on Top Layer: 67.82,59.33 66.61,60.54 62.29,60.54 62.22,60.47 62.22,57.07 66.61,57.07 67.85,58.31 70.39,58.31 69.38,59.33
$1N4315 on Top Layer: 67.68,48.02 66.46,49.24 62.15,49.24 62.08,49.17 62.08,45.77 66.46,45.77 67.7,47.01 70.25,47.01 69.23,48.02
$1N4721 on Top Layer: 67.45,36.83 66.23,38.05 61.92,38.05 61.85,37.98 61.85,34.58 66.23,34.58 67.47,35.82 70.02,35.82 69,36.83
$1N4748 on Top Layer: 70.14,34.3 69.91,34.54 67.65,34.54 67.44,34.32 67.44,33.66 67.69,33.41 69.87,33.41 70.14,33.67
$1N4784 on Top Layer: 70.4,45.6 70.17,45.83 67.79,45.83 67.57,45.61 67.57,44.83 67.95,44.45 70.14,44.45 70.4,44.71
$1N4807 on Top Layer: 70.63,56.85 70.4,57.08 68.02,57.08 67.8,56.87 67.8,56.08 68.18,55.7 70.36,55.7 70.63,55.97
$1N11173 on Top Layer: 85.81,30.36 85.34,30.82 85.34,37.09 83.95,38.48 83.95,40.52 84.58,41.15 91.51,41.15 92.17,40.49 92.17,30.9 91.63,30.36
$1N11173 on Bottom Layer: 85.8,30.32 85.33,30.78 85.33,37.05 83.94,38.45 83.94,40.48 84.57,41.11 91.5,41.11 92.16,40.45 92.16,30.86 91.62,30.32
$1N11173 on Inner2: 85.81,30.36 85.34,30.82 85.34,37.09 83.95,38.48 83.95,40.52 84.58,41.15 91.51,41.15 92.17,40.49 92.17,30.9 91.63,30.36
$1N19049 on Bottom Layer: 85.41,19.31 85.41,22.16 85.09,22.48 84.2,22.48 83.95,22.23 83.95,20.29 84.58,19.65 84.58,19.05 85.15,19.05
$1N19262 on Top Layer: 90.41,18.65 91.54,19.77 92.41,19.77 93.09,20.45 93.09,28.71 92.58,29.21 81.43,29.21 81.09,28.88 81.09,26.1 81.53,25.66 84.84,25.66 85.72,24.77 85.72,20.71 85.98,20.45 88.54,20.45 89.03,19.97 89.03,19.05 89.43,18.65
$1N19262 on Bottom Layer: 90.41,18.65 91.54,19.77 92.41,19.77 93.09,20.45 93.09,28.71 92.58,29.21 81.43,29.21 81.09,28.88 81.09,26.1 81.53,25.66 84.84,25.66 85.72,24.77 85.72,20.71 85.98,20.45 88.54,20.45 89.03,19.97 89.03,19.05 89.43,18.65
$1N19262 on Inner2: 90.41,18.65 91.54,19.77 92.41,19.77 93.09,20.45 93.09,28.71 92.58,29.21 81.43,29.21 81.09,28.88 81.09,26.1 81.53,25.66 84.84,25.66 85.72,24.77 85.72,20.71 85.98,20.45 88.54,20.45 89.03,19.97 89.03,19.05 89.43,18.65

Small or netless copper shapes (teardrops, artwork), in the pictures only: 468 on Top Layer, 236 on Bottom Layer, 51 on Inner1, 45 on Inner2

## Text on the board
Bottom Silkscreen Layer: GND | E_RX | E_TX | TX2 | RX2 | RX1 | TX1 | RST | SDO | SCL | 3V3 | Cerberus_V02 | I2C1_SCL | LC02 | BAT_7V4 | RX4 | TX4 | 5V_OUT | BAT_ADC | I2C1_SDA
Top Silkscreen Layer: Cerberus_Sub_Controller_v02 / By Connor.C / Func : Sub_Controller_Test / Time : 2024/08/29
